# EasyEDA Pro project ProProject_IMUSensorNodes202312.epro, board 6_6_拼板20240123（不带编号） (continued)
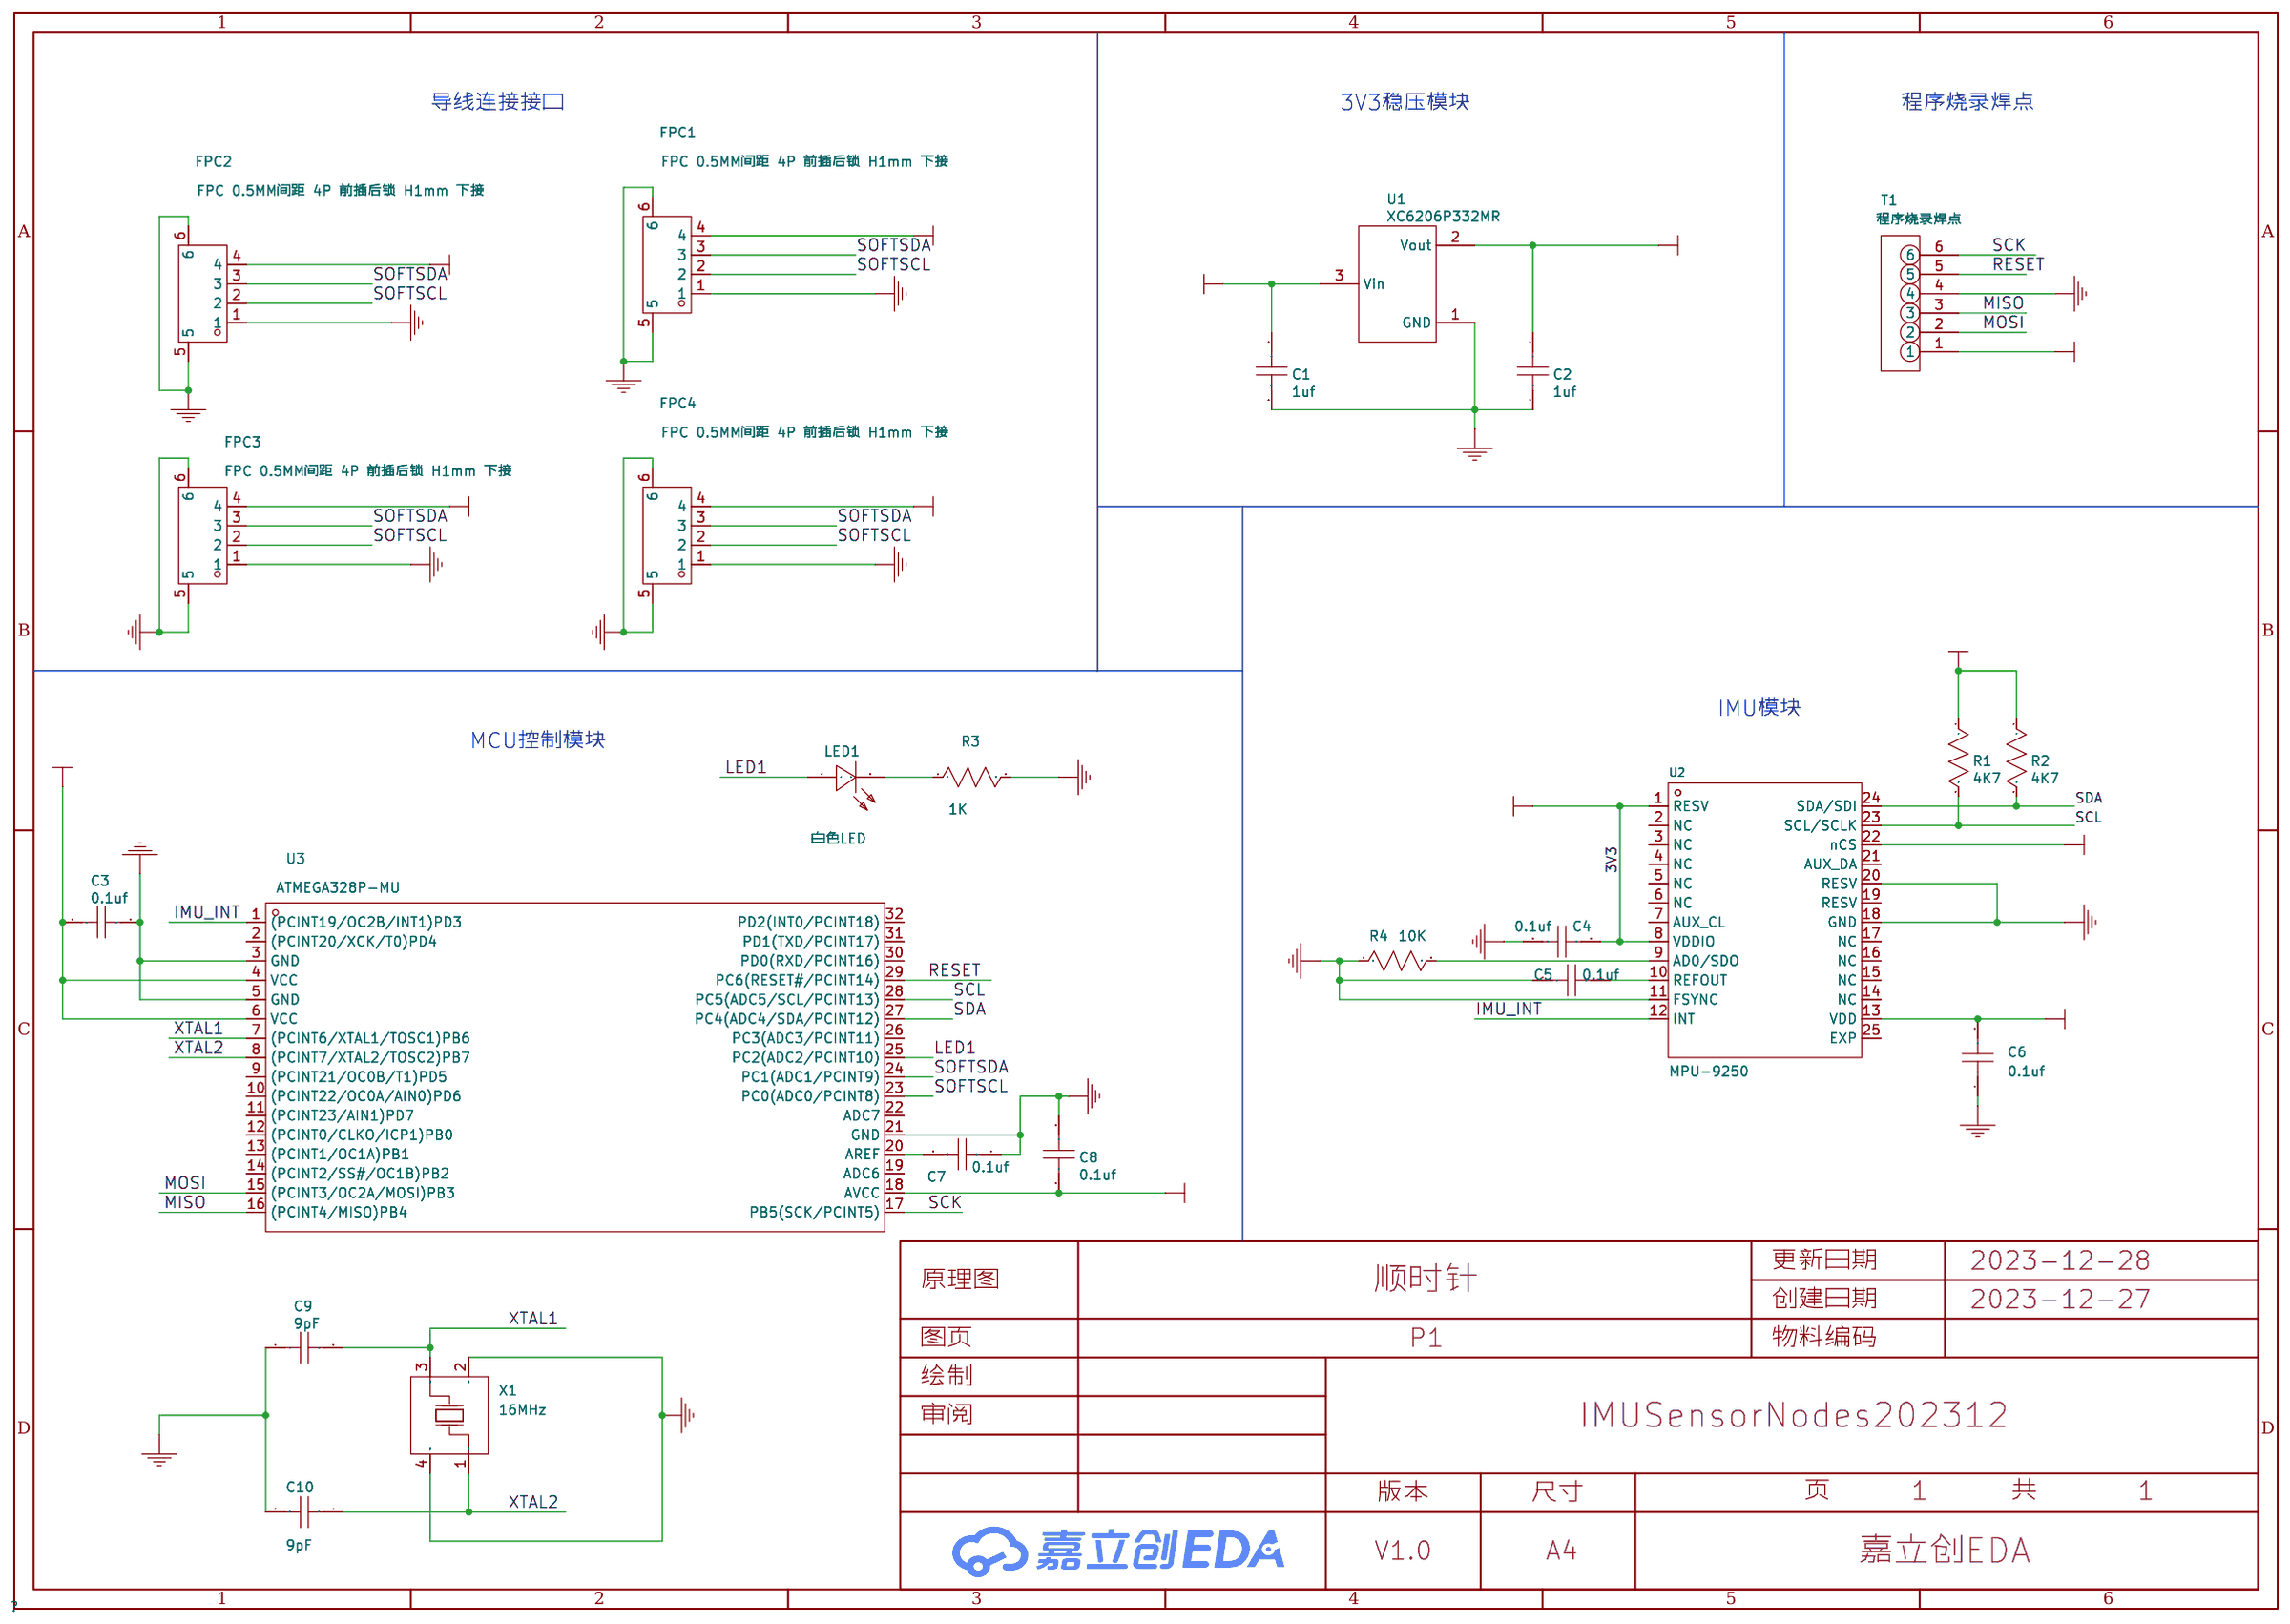
[diagram p0: schematic sheet]
## Nets (continued)
SOFTSCL: FPC1.3 FPC1#2.3 FPC1#3.2 FPC1#4.3 FPC1#5.3 FPC1#6.3 FPC1#7.2 FPC1#8.3 FPC1#9.2 FPC1#10.2 FPC1#11.2 FPC1#12.3 FPC1#13.3 FPC1#14.3 FPC1#15.2 FPC1#16.2 FPC1#17.3 FPC1#18.3 FPC1#19.2 FPC1#20.2 FPC1#21.3 FPC1#22.2 FPC1#23.2 FPC1#24.3 FPC1#25.2 FPC1#26.2 FPC1#27.2 FPC1#28.3 FPC1#29.2 FPC1#30.2 FPC1#31.3 FPC1#32.3 FPC1#33.2 FPC1#34.3 FPC1#35.2 FPC1#36.3 FPC2.2 FPC2#2.2 FPC2#3.2 FPC2#4.3 FPC2#5.2 FPC2#6.3 FPC2#7.3 FPC2#8.3 FPC2#9.3 FPC2#10.3 FPC2#11.3 FPC2#12.3 FPC2#13.3 FPC2#14.2 FPC2#15.2 FPC2#16.2 FPC2#17.2 FPC2#18.2 FPC2#19.3 FPC2#20.2 FPC2#21.3 FPC2#22.2 FPC2#23.3 FPC2#24.2 FPC2#25.3 FPC2#26.2 FPC2#27.2 FPC2#28.2 FPC2#29.2 FPC2#30.2 FPC2#31.2 FPC2#32.3 FPC2#33.3 FPC2#34.3 FPC2#35.3 FPC2#36.3 FPC3.3 FPC3#2.2 FPC3#3.2 FPC3#4.2 FPC3#5.3 FPC3#6.3 FPC3#7.2 FPC3#8.3 FPC3#9.2 FPC3#10.3 FPC3#11.2 FPC3#12.3 FPC3#13.3 FPC3#14.3 FPC3#15.3 FPC3#16.2 FPC3#17.3 FPC3#18.2 FPC3#19.2 FPC3#20.3 FPC3#21.2 FPC3#22.2 FPC3#23.2 FPC3#24.2 FPC3#25.3 FPC3#26.3 FPC3#27.3 FPC3#28.2 FPC3#29.2 FPC3#30.3 FPC3#31.3 FPC3#32.3 FPC3#33.2 FPC3#34.2 FPC3#35.2 FPC3#36.3 FPC4.3 FPC4#2.2 FPC4#3.3 FPC4#4.2 FPC4#5.2 FPC4#6.3 FPC4#7.3 FPC4#8.3 FPC4#9.2 FPC4#10.2 FPC4#11.3 FPC4#12.3 FPC4#13.3 FPC4#14.2 FPC4#15.2 FPC4#16.2 FPC4#17.3 FPC4#18.3 FPC4#19.3 FPC4#20.2 FPC4#21.2 FPC4#22.2 FPC4#23.3 FPC4#24.2 FPC4#25.3 FPC4#26.2 FPC4#27.3 FPC4#28.2 FPC4#29.2 FPC4#30.3 FPC4#31.2 FPC4#32.2 FPC4#33.3 FPC4#34.2 FPC4#35.3 FPC4#36.3 U3#61.23 U3#62.23 U3#63.23 U3#64.23 U3#65.23 U3#66.23 U3#67.23 U3#68.23 U3#69.23 U3#70.23 U3#71.23 U3#72.23 U3#73.23 U3#74.23 U3#75.23 U3#76.23 U3#77.23 U3#78.23 U3#79.23 U3#80.23 U3#81.23 U3#82.23 U3#83.23 U3#84.23 U3#85.23 U3#86.23 U3#87.23 U3#88.23 U3#89.23 U3#90.23 U3#91.23 U3#92.23 U3#93.23 U3#94.23 U3#95.23 U3#96.23
SOFTSDA: FPC1.2 FPC1#2.2 FPC1#3.3 FPC1#4.2 FPC1#5.2 FPC1#6.2 FPC1#7.3 FPC1#8.2 FPC1#9.3 FPC1#10.3 FPC1#11.3 FPC1#12.2 FPC1#13.2 FPC1#14.2 FPC1#15.3 FPC1#16.3 FPC1#17.2 FPC1#18.2 FPC1#19.3 FPC1#20.3 FPC1#21.2 FPC1#22.3 FPC1#23.3 FPC1#24.2 FPC1#25.3 FPC1#26.3 FPC1#27.3 FPC1#28.2 FPC1#29.3 FPC1#30.3 FPC1#31.2 FPC1#32.2 FPC1#33.3 FPC1#34.2 FPC1#35.3 FPC1#36.2 FPC2.3 FPC2#2.3 FPC2#3.3 FPC2#4.2 FPC2#5.3 FPC2#6.2 FPC2#7.2 FPC2#8.2 FPC2#9.2 FPC2#10.2 FPC2#11.2 FPC2#12.2 FPC2#13.2 FPC2#14.3 FPC2#15.3 FPC2#16.3 FPC2#17.3 FPC2#18.3 FPC2#19.2 FPC2#20.3 FPC2#21.2 FPC2#22.3 FPC2#23.2 FPC2#24.3 FPC2#25.2 FPC2#26.3 FPC2#27.3 FPC2#28.3 FPC2#29.3 FPC2#30.3 FPC2#31.3 FPC2#32.2 FPC2#33.2 FPC2#34.2 FPC2#35.2 FPC2#36.2 FPC3.2 FPC3#2.3 FPC3#3.3 FPC3#4.3 FPC3#5.2 FPC3#6.2 FPC3#7.3 FPC3#8.2 FPC3#9.3 FPC3#10.2 FPC3#11.3 FPC3#12.2 FPC3#13.2 FPC3#14.2 FPC3#15.2 FPC3#16.3 FPC3#17.2 FPC3#18.3 FPC3#19.3 FPC3#20.2 FPC3#21.3 FPC3#22.3 FPC3#23.3 FPC3#24.3 FPC3#25.2 FPC3#26.2 FPC3#27.2 FPC3#28.3 FPC3#29.3 FPC3#30.2 FPC3#31.2 FPC3#32.2 FPC3#33.3 FPC3#34.3 FPC3#35.3 FPC3#36.2 FPC4.2 FPC4#2.3 FPC4#3.2 FPC4#4.3 FPC4#5.3 FPC4#6.2 FPC4#7.2 FPC4#8.2 FPC4#9.3 FPC4#10.3 FPC4#11.2 FPC4#12.2 FPC4#13.2 FPC4#14.3 FPC4#15.3 FPC4#16.3 FPC4#17.2 FPC4#18.2 FPC4#19.2 FPC4#20.3 FPC4#21.3 FPC4#22.3 FPC4#23.2 FPC4#24.3 FPC4#25.2 FPC4#26.3 FPC4#27.2 FPC4#28.3 FPC4#29.3 FPC4#30.2 FPC4#31.3 FPC4#32.3 FPC4#33.2 FPC4#34.3 FPC4#35.2 FPC4#36.2 U3#61.24 U3#62.24 U3#63.24 U3#64.24 U3#65.24 U3#66.24 U3#67.24 U3#68.24 U3#69.24 U3#70.24 U3#71.24 U3#72.24 U3#73.24 U3#74.24 U3#75.24 U3#76.24 U3#77.24 U3#78.24 U3#79.24 U3#80.24 U3#81.24 U3#82.24 U3#83.24 U3#84.24 U3#85.24 U3#86.24 U3#87.24 U3#88.24 U3#89.24 U3#90.24 U3#91.24 U3#92.24 U3#93.24 U3#94.24 U3#95.24 U3#96.24
XTAL1: C9.2 C9#2.2 C9#3.2 C9#4.2 C9#5.2 C9#6.2 C9#7.2 C9#8.2 C9#9.2 C9#10.2 C9#11.2 C9#12.2 C9#13.2 C9#14.2 C9#15.2 C9#16.2 C9#17.2 C9#18.2 C9#19.2 C9#20.2 C9#21.2 C9#22.2 C9#23.2 C9#24.2 C9#25.2 C9#26.2 C9#27.2 C9#28.2 C9#29.2 C9#30.2 C9#31.2 C9#32.2 C9#33.2 C9#34.2 C9#35.2 C9#36.2 U3#61.7 U3#62.7 U3#63.7 U3#64.7 U3#65.7 U3#66.7 U3#67.7 U3#68.7 U3#69.7 U3#70.7 U3#71.7 U3#72.7 U3#73.7 U3#74.7 U3#75.7 U3#76.7 U3#77.7 U3#78.7 U3#79.7 U3#80.7 U3#81.7 U3#82.7 U3#83.7 U3#84.7 U3#85.7 U3#86.7 U3#87.7 U3#88.7 U3#89.7 U3#90.7 U3#91.7 U3#92.7 U3#93.7 U3#94.7 U3#95.7 U3#96.7 X1.3 X1#2.3 X1#3.3 X1#4.3 X1#5.3 X1#6.3 X1#7.3 X1#8.3 X1#9.3 X1#10.3 X1#11.3 X1#12.3 X1#13.3 X1#14.3 X1#15.3 X1#16.3 X1#17.3 X1#18.3 X1#19.3 X1#20.3 X1#21.3 X1#22.3 X1#23.3 X1#24.3 X1#25.3 X1#26.3 X1#27.3 X1#28.3 X1#29.3 X1#30.3 X1#31.3 X1#32.3 X1#33.3 X1#34.3 X1#35.3 X1#36.3
XTAL2: C10.1 C10#2.1 C10#3.1 C10#4.1 C10#5.1 C10#6.1 C10#7.1 C10#8.1 C10#9.1 C10#10.1 C10#11.1 C10#12.1 C10#13.1 C10#14.1 C10#15.1 C10#16.1 C10#17.1 C10#18.1 C10#19.1 C10#20.1 C10#21.1 C10#22.1 C10#23.1 C10#24.1 C10#25.1 C10#26.1 C10#27.1 C10#28.1 C10#29.1 C10#30.1 C10#31.1 C10#32.1 C10#33.1 C10#34.1 C10#35.1 C10#36.1 U3#61.8 U3#62.8 U3#63.8 U3#64.8 U3#65.8 U3#66.8 U3#67.8 U3#68.8 U3#69.8 U3#70.8 U3#71.8 U3#72.8 U3#73.8 U3#74.8 U3#75.8 U3#76.8 U3#77.8 U3#78.8 U3#79.8 U3#80.8 U3#81.8 U3#82.8 U3#83.8 U3#84.8 U3#85.8 U3#86.8 U3#87.8 U3#88.8 U3#89.8 U3#90.8 U3#91.8 U3#92.8 U3#93.8 U3#94.8 U3#95.8 U3#96.8 X1.1 X1#2.1 X1#3.1 X1#4.1 X1#5.1 X1#6.1 X1#7.1 X1#8.1 X1#9.1 X1#10.1 X1#11.1 X1#12.1 X1#13.1 X1#14.1 X1#15.1 X1#16.1 X1#17.1 X1#18.1 X1#19.1 X1#20.1 X1#21.1 X1#22.1 X1#23.1 X1#24.1 X1#25.1 X1#26.1 X1#27.1 X1#28.1 X1#29.1 X1#30.1 X1#31.1 X1#32.1 X1#33.1 X1#34.1 X1#35.1 X1#36.1
$1N1083: LED1#2.2 LED1#4.2 LED1#7.2 LED1#9.2 LED1#11.2 LED1#13.2 LED1#15.2 LED1#17.2 LED1#19.2 LED1#20.2 LED1#22.2 LED1#24.2 LED1#26.2 LED1#28.2 LED1#30.2 LED1#32.2 LED1#34.2 LED1#36.2 R3#2.1 R3#4.1 R3#7.1 R3#9.1 R3#11.1 R3#13.1 R3#15.1 R3#17.1 R3#19.1 R3#20.1 R3#22.1 R3#24.1 R3#26.1 R3#28.1 R3#30.1 R3#32.1 R3#34.1 R3#36.1
$1N1108: C7#2.2 C7#4.2 C7#7.2 C7#9.2 C7#11.2 C7#13.2 C7#15.2 C7#17.2 C7#19.2 C7#20.2 C7#22.2 C7#24.2 C7#26.2 C7#28.2 C7#30.2 C7#32.2 C7#34.2 C7#36.2 U3#63.20 U3#65.20 U3#66.20 U3#68.20 U3#70.20 U3#72.20 U3#73.20 U3#74.20 U3#75.20 U3#76.20 U3#77.20 U3#82.20 U3#85.20 U3#89.20 U3#91.20 U3#92.20 U3#93.20 U3#96.20
$1N1134: LED1.2 LED1#3.2 LED1#5.2 LED1#6.2 LED1#8.2 LED1#10.2 LED1#12.2 LED1#14.2 LED1#16.2 LED1#18.2 LED1#21.2 LED1#23.2 LED1#25.2 LED1#27.2 LED1#29.2 LED1#31.2 LED1#33.2 LED1#35.2 R3.1 R3#3.1 R3#5.1 R3#6.1 R3#8.1 R3#10.1 R3#12.1 R3#14.1 R3#16.1 R3#18.1 R3#21.1 R3#23.1 R3#25.1 R3#27.1 R3#29.1 R3#31.1 R3#33.1 R3#35.1
$1N1156: C7.2 C7#3.2 C7#5.2 C7#6.2 C7#8.2 C7#10.2 C7#12.2 C7#14.2 C7#16.2 C7#18.2 C7#21.2 C7#23.2 C7#25.2 C7#27.2 C7#29.2 C7#31.2 C7#33.2 C7#35.2 U3#61.20 U3#62.20 U3#64.20 U3#67.20 U3#69.20 U3#71.20 U3#78.20 U3#79.20 U3#80.20 U3#81.20 U3#83.20 U3#84.20 U3#86.20 U3#87.20 U3#88.20 U3#90.20 U3#94.20 U3#95.20
$1N1216: R4.2 R4#2.2 R4#4.2 R4#6.2 R4#7.2 R4#9.2 R4#11.2 R4#14.2 R4#16.2 R4#18.2 R4#21.2 R4#23.2 R4#25.2 R4#27.2 R4#29.2 R4#31.2 R4#33.2 R4#35.2 U2#2.9 U2#3.9 U2#5.9 U2#6.9 U2#7.9 U2#12.9 U2#14.9 U2#16.9 U2#18.9 U2#19.9 U2#20.9 U2#22.9 U2#24.9 U2#28.9 U2#32.9 U2#34.9 U2#35.9 U2#36.9
$1N1217: C5.2 C5#3.2 C5#5.2 C5#7.2 C5#8.2 C5#10.2 C5#12.2 C5#15.2 C5#17.2 C5#19.2 C5#21.2 C5#24.2 C5#26.2 C5#28.2 C5#30.2 C5#32.2 C5#34.2 C5#36.2 U2#2.10 U2#3.10 U2#5.10 U2#6.10 U2#7.10 U2#12.10 U2#14.10 U2#16.10 U2#18.10 U2#19.10 U2#20.10 U2#22.10 U2#24.10 U2#28.10 U2#32.10 U2#34.10 U2#35.10 U2#36.10
$1N1698: R4#3.2 R4#5.2 R4#8.2 R4#10.2 R4#12.2 R4#13.2 R4#15.2 R4#17.2 R4#19.2 R4#20.2 R4#22.2 R4#24.2 R4#26.2 R4#28.2 R4#30.2 R4#32.2 R4#34.2 R4#36.2 U2.9 U2#4.9 U2#8.9 U2#9.9 U2#10.9 U2#11.9 U2#13.9 U2#15.9 U2#17.9 U2#21.9 U2#23.9 U2#25.9 U2#26.9 U2#27.9 U2#29.9 U2#30.9 U2#31.9 U2#33.9
$1N1725: C5#2.2 C5#4.2 C5#6.2 C5#9.2 C5#11.2 C5#13.2 C5#14.2 C5#16.2 C5#18.2 C5#20.2 C5#22.2 C5#23.2 C5#25.2 C5#27.2 C5#29.2 C5#31.2 C5#33.2 C5#35.2 U2.10 U2#4.10 U2#8.10 U2#9.10 U2#10.10 U2#11.10 U2#13.10 U2#15.10 U2#17.10 U2#21.10 U2#23.10 U2#25.10 U2#26.10 U2#27.10 U2#29.10 U2#30.10 U2#31.10 U2#33.10

Pads without a net: U2 2 3 4 5 6 14 15 16 17 19 21; U2#2 2 3 4 5 6 7 14 15 16 17 19 21; U2#3 2 3 4 5 6 7 14 15 16 17 19 21; U2#4 2 3 4 5 6 14 15 16 17 19 21; U2#5 2 3 4 5 6 7 14 15 16 17 19 21; U2#6 2 3 4 5 6 7 14 15 16 17 19 21; U2#7 2 3 4 5 6 7 14 15 16 17 19 21; U2#8 2 3 4 5 6 14 15 16 17 19 21; U2#9 2 3 4 5 6 14 15 16 17 19 21; U2#10 2 3 4 5 6 14 15 16 17 19 21; U2#11 2 3 4 5 6 14 15 16 17 19 21; U2#12 2 3 4 5 6 7 14 15 16 17 19 21; U2#13 2 3 4 5 6 14 15 16 17 19 21; U2#14 2 3 4 5 6 7 14 15 16 17 19 21; U2#15 2 3 4 5 6 14 15 16 17 19 21; U2#16 2 3 4 5 6 7 14 15 16 17 19 21; U2#17 2 3 4 5 6 14 15 16 17 19 21; U2#18 2 3 4 5 6 7 14 15 16 17 19 21; U2#19 2 3 4 5 6 7 14 15 16 17 19 21; U2#20 2 3 4 5 6 7 14 15 16 17 19 21; U2#21 2 3 4 5 6 14 15 16 17 19 21; U2#22 2 3 4 5 6 7 14 15 16 17 19 21; U2#23 2 3 4 5 6 14 15 16 17 19 21; U2#24 2 3 4 5 6 7 14 15 16 17 19 21; U2#25 2 3 4 5 6 14 15 16 17 19 21; U2#26 2 3 4 5 6 14 15 16 17 19 21; U2#27 2 3 4 5 6 14 15 16 17 19 21; U2#28 2 3 4 5 6 7 14 15 16 17 19 21; U2#29 2 3 4 5 6 14 15 16 17 19 21; U2#30 2 3 4 5 6 14 15 16 17 19 21; U2#31 2 3 4 5 6 14 15 16 17 19 21; U2#32 2 3 4 5 6 7 14 15 16 17 19 21; U2#33 2 3 4 5 6 14 15 16 17 19 21; U2#34 2 3 4 5 6 7 14 15 16 17 19 21; U2#35 2 3 4 5 6 7 14 15 16 17 19 21; U2#36 2 3 4 5 6 7 14 15 16 17 19 21; U3 1 2 3 4 5 6 7 8 9 10 11 12 13 14 15 16; U3#2 1 2 3 4 5 6 7 8 9 10 11 12 13 14 15 16; U3#3 1 2 3 4 5 6 7 8 9 10 11 12 13 14 15 16; U3#4 1 2 3 4 5 6 7 8 9 10 11 12 13 14 15 16; U3#5 1 2 3 4 5 6 7 8 9 10 11 12 13 14 15 16; U3#6 1 2 3 4 5 6 7 8 9 10 11 12 13 14 15 16; U3#7 1 2 3 4 5 6 7 8 9 10 11 12 13 14 15 16; U3#8 1 2 3 4 5 6 7 8 9 10 11 12 13 14 15 16; U3#9 1 2 3 4 5 6 7 8 9 10 11 12 13 14 15 16; U3#10 1 2 3 4 5 6 7 8 9 10 11 12 13 14 15 16; U3#11 1 2 3 4 5 6 7 8 9 10 11 12 13 14 15 16; U3#12 1 2 3 4 5 6 7 8 9 10 11 12 13 14 15 16; U3#13 1 2 3 4 5 6 7 8 9 10 11 12 13 14 15 16; U3#14 1 2 3 4 5 6 7 8 9 10 11 12 13 14 15 16; U3#15 1 2 3 4 5 6 7 8 9 10 11 12 13 14 15 16; U3#16 1 2 3 4 5 6 7 8 9 10 11 12 13 14 15 16; U3#17 1 2 3 4 5 6 7 8 9 10 11 12 13 14 15 16; U3#18 1 2 3 4 5 6 7 8 9 10 11 12 13 14 15 16; U3#19 1 2 3 4 5 6 7 8 9 10 11 12 13 14 15 16; U3#20 1 2 3 4 5 6 7 8 9 10 11 12 13 14 15 16; U3#21 1 2 3 4 5 6 7 8 9 10 11 12 13 14 15 16; U3#22 1 2 3 4 5 6 7 8 9 10 11 12 13 14 15 16; U3#23 1 2 3 4 5 6 7 8 9 10 11 12 13 14 15 16; U3#24 1 2 3 4 5 6 7 8 9 10 11 12 13 14 15 16; U3#25 1 2 3 4 5 6 7 8 9 10 11 12 13 14 15 16; U3#26 1 2 3 4 5 6 7 8 9 10 11 12 13 14 15 16; U3#27 1 2 3 4 5 6 7 8 9 10 11 12 13 14 15 16; U3#28 1 2 3 4 5 6 7 8 9 10 11 12 13 14 15 16; U3#29 1 2 3 4 5 6 7 8 9 10 11 12 13 14 15 16; U3#30 1 2 3 4 5 6 7 8 9 10 11 12 13 14 15 16; U3#31 1 2 3 4 5 6 7 8 9 10 11 12 13 14 15 16; U3#32 1 2 3 4 5 6 7 8 9 10 11 12 13 14 15 16; U3#33 1 2 3 4 5 6 7 8 9 10 11 12 13 14 15 16; U3#34 1 2 3 4 5 6 7 8 9 10 11 12 13 14 15 16; U3#35 1 2 3 4 5 6 7 8 9 10 11 12 13 14 15 16; U3#36 1 2 3 4 5 6 7 8 9 10 11 12 13 14 15 16; U3#37 1 2 3 4 5 6 7 8 9 10 11 12 13 14 15 16; U3#38 1 2 3 4 5 6 7 8 9 10 11 12 13 14 15 16; U3#39 1 2 3 4 5 6 7 8 9 10 11 12 13 14 15 16; U3#40 1 2 3 4 5 6 7 8 9 10 11 12 13 14 15 16; U3#41 1 2 3 4 5 6 7 8 9 10 11 12 13 14 15 16; U3#42 1 2 3 4 5 6 7 8 9 10 11 12 13 14 15 16; U3#43 1 2 3 4 5 6 7 8 9 10 11 12 13 14 15 16; U3#44 1 2 3 4 5 6 7 8 9 10 11 12 13 14 15 16; U3#45 1 2 3 4 5 6 7 8 9 10 11 12 13 14 15 16; U3#46 1 2 3 4 5 6 7 8 9 10 11 12 13 14 15 16; U3#47 1 2 3 4 5 6 7 8 9 10 11 12 13 14 15 16; U3#48 1 2 3 4 5 6 7 8 9 10 11 12 13 14 15 16; U3#49 1 2 3 4 5 6 7 8 9 10 11 12 13 14 15 16; U3#50 1 2 3 4 5 6 7 8 9 10 11 12 13 14 15 16; U3#51 1 2 3 4 5 6 7 8 9 10 11 12 13 14 15 16; U3#52 1 2 3 4 5 6 7 8 9 10 11 12 13 14 15 16; U3#53 1 2 3 4 5 6 7 8 9 10 11 12 13 14 15 16; U3#54 1 2 3 4 5 6 7 8 9 10 11 12 13 14 15 16; U3#55 1 2 3 4 5 6 7 8 9 10 11 12 13 14 15 16; U3#56 1 2 3 4 5 6 7 8 9 10 11 12 13 14 15 16; U3#57 1 2 3 4 5 6 7 8 9 10 11 12 13 14 15 16; U3#58 1 2 3 4 5 6 7 8 9 10 11 12 13 14 15 16; U3#59 1 2 3 4 5 6 7 8 9 10 11 12 13 14 15 16; U3#60 1 2 3 4 5 6 7 8 9 10 11 12 13 14 15 16; U3#61 2 9 10 11 12 14 19 31 32; U3#62 2 9 10 11 12 14 19 31 32; U3#63 2 10 11 12 13 19 32; U3#64 2 9 10 11 12 14 19 31 32; U3#65 2 10 11 12 13 19 32; U3#66 2 10 11 12 13 19 32; U3#67 2 9 10 11 12 14 19 31 32; U3#68 2 10 11 12 13 19 32; U3#69 2 9 10 11 12 14 19 31 32; U3#70 2 10 11 12 13 19 32; U3#71 2 9 10 11 12 14 19 31 32; U3#72 2 10 11 12 13 19 32; U3#73 2 10 11 12 13 19 32; U3#74 2 10 11 12 13 19 32; U3#75 2 10 11 12 13 19 32; U3#76 2 10 11 12 13 19 32; U3#77 2 10 11 12 13 19 32; U3#78 2 9 10 11 12 14 19 31 32; U3#79 2 9 10 11 12 14 19 31 32; U3#80 2 9 10 11 12 14 19 31 32; U3#81 2 9 10 11 12 14 19 31 32; U3#82 2 10 11 12 13 19 32; U3#83 2 9 10 11 12 14 19 31 32; U3#84 2 9 10 11 12 14 19 31 32; U3#85 2 10 11 12 13 19 32; U3#86 2 9 10 11 12 14 19 31 32; U3#87 2 9 10 11 12 14 19 31 32; U3#88 2 9 10 11 12 14 19 31 32; U3#89 2 10 11 12 13 19 32; U3#90 2 9 10 11 12 14 19 31 32; U3#91 2 10 11 12 13 19 32; U3#92 2 10 11 12 13 19 32; U3#93 2 10 11 12 13 19 32; U3#94 2 9 10 11 12 14 19 31 32; U3#95 2 9 10 11 12 14 19 31 32; U3#96 2 10 11 12 13 19 32

## Via types
v1: diameter 0.5, hole 0.3, Top Layer to Bottom Layer, 1188 vias
v2: diameter 0.5, hole 0.299, Top Layer to Bottom Layer, 108 vias

## Routing (per net, layer and track width the routed paths; a pad name or vN(x,y) marks a point on that pad's centre or on a via; arc(x,y) is an arc through that point)
3V3: length 1145
  Top Layer w0.254: v1(75.22,14.89) 76.99,16.67 v1(76.99,17.56) ; v1(28.22,51.84) 28.22,50.7 v1(28.35,50.58) 28.48,50.45 29.68,50.45 v1(29.77,50.36) ; v1(2.46,9.21) 2.37,9.3 1.17,9.3 v1(1.05,9.43) 0.92,9.55 v1(0.92,10.7) ; v1(16.16,8.92) 15.45,8.92 v1(14.94,9.43) ; v1(55.53,24.41) 55.53,23.27 v1(55.66,23.14) 55.78,23.02 56.98,23.02 v1(57.07,22.92) ; v1(43.47,22.64) 42.75,22.64 v1(42.25,23.14) ; v1(2.46,36.64) 2.37,36.73 1.17,36.73 v1(1.05,36.86) 0.92,36.99 v1(0.92,38.13) ; v1(47.91,28.6) 49.69,30.38 v1(49.69,31.27) ; v1(20.6,56.04) 22.38,57.81 v1(22.38,58.7) ; v1(75.22,1.17) 76.99,2.95 v1(76.99,3.84) ; v1(42.25,78.01) 42.75,77.5 v1(43.47,77.5) ; v1(75.22,56.04) 76.99,57.81 v1(76.99,58.7) ; v1(47.91,14.89) 49.69,16.67 v1(49.69,17.56) ; v1(69.55,64.29) 70.06,63.78 v1(70.77,63.78) ; v1(43.47,36.35) 42.75,36.35 v1(42.25,36.86) ; v1(69.55,36.86) 70.06,36.35 v1(70.77,36.35) ; v1(49.69,72.42) 49.69,71.53 v1(47.91,69.75) ; v1(69.55,50.58) 70.06,50.07 v1(70.77,50.07) ; v1(75.22,42.32) 76.99,44.1 v1(76.99,44.99) ; v1(70.77,8.92) 70.06,8.92 v1(69.55,9.43) ; v1(55.53,10.7) 55.53,9.55 v1(55.66,9.43) 55.78,9.3 56.98,9.3 v1(57.07,9.21) ; v1(47.91,42.32) 49.69,44.1 v1(49.69,44.99) ; v1(22.38,72.42) 22.38,71.53 v1(20.6,69.75) ; v1(14.94,78.01) 15.45,77.5 v1(16.16,77.5) ; v1(57.07,64.07) 56.98,64.16 55.78,64.16 v1(55.66,64.29) 55.53,64.42 v1(55.53,65.56) ; v1(29.77,77.79) 29.68,77.88 28.48,77.88 v1(28.35,78.01) 28.22,78.13 v1(28.22,79.28) ; v1(22.38,17.56) 22.38,16.67 v1(20.6,14.89) ; v1(70.77,77.5) 70.06,77.5 v1(69.55,78.01) ; v1(29.77,36.64) 29.68,36.73 28.48,36.73 v1(28.35,36.86) 28.22,36.99 v1(28.22,38.13) ; v1(28.22,24.41) 28.22,23.27 v1(28.35,23.14) 28.48,23.02 29.68,23.02 v1(29.77,22.92) ; v1(14.94,23.14) 15.45,22.64 v1(16.16,22.64) ; v1(49.69,58.7) 49.69,57.81 v1(47.91,56.04) ; v1(42.25,50.58) 42.75,50.07 v1(43.47,50.07) ; v1(57.07,36.64) 56.98,36.73 55.78,36.73 v1(55.66,36.86) 55.53,36.99 v1(55.53,38.13) ; v1(49.69,3.84) 49.69,2.95 v1(47.91,1.17) ; v1(14.94,50.58) 15.45,50.07 v1(16.16,50.07) ; v1(22.38,31.27) 22.38,30.38 v1(20.6,28.6) ; v1(28.22,10.7) 28.22,9.55 v1(28.35,9.43) 28.48,9.3 29.68,9.3 v1(29.77,9.21) ; v1(57.07,50.36) 56.98,50.45 55.78,50.45 v1(55.66,50.58) 55.53,50.7 v1(55.53,51.84) ; v1(16.16,36.35) 15.45,36.35 v1(14.94,36.86) ; v1(75.22,28.6) 76.99,30.38 v1(76.99,31.27) ; v1(57.07,77.79) 56.98,77.88 55.78,77.88 v1(55.66,78.01) 55.53,78.13 v1(55.53,79.28) ; v1(0.92,65.56) 0.92,64.42 v1(1.05,64.29) 1.17,64.16 2.37,64.16 v1(2.46,64.07) ; v1(76.99,72.42) 76.99,71.53 v1(75.22,69.75) ; v1(42.25,9.43) 42.75,8.92 v1(43.47,8.92) ; v1(22.38,44.99) 22.38,44.1 v1(20.6,42.32) ; v1(2.46,77.79) 2.37,77.88 1.17,77.88 v1(1.05,78.01) 0.92,78.13 v1(0.92,79.28) ; v1(69.55,23.14) 70.06,22.64 v1(70.77,22.64) ; v1(43.47,63.78) 42.75,63.78 v1(42.25,64.29) ; v1(29.77,64.07) 29.68,64.16 28.48,64.16 v1(28.35,64.29) 28.22,64.42 v1(28.22,65.56) ; v1(0.92,24.41) 0.92,23.27 v1(1.05,23.14) 1.17,23.02 2.37,23.02 v1(2.46,22.92) ; v1(16.16,63.78) 15.45,63.78 v1(14.94,64.29) ; v1(20.6,1.17) 22.38,2.95 v1(22.38,3.84) ; v1(2.46,50.36) 2.37,50.45 1.17,50.45 v1(1.05,50.58) 0.92,50.7 v1(0.92,51.84)
  Bottom Layer w0.2: 1.81,11.46 3.59,11.46 3.6,11.44 U2#11.1 ; U2#23.1 58.21,11.44 58.2,11.46 56.42,11.46 ; 1.81,52.61 3.59,52.61 3.6,52.59 U2#30.1 ; 1.81,80.04 3.59,80.04 3.6,80.02 U2.1 ; U2#33.1 3.6,25.16 3.59,25.17 1.81,25.17 ; 56.42,38.89 58.2,38.89 58.21,38.87 U2#10.1 ; U2#26.1 58.21,52.59 58.2,52.61 56.42,52.61 ; U2#17.1 58.21,25.16 58.2,25.17 56.42,25.17 ; U2#4.1 3.6,38.87 3.59,38.89 1.81,38.89 ; U2#31.1 30.91,66.31 30.89,66.32 29.11,66.32 ; U2#8.1 30.91,38.87 30.89,38.89 29.11,38.89 ; 29.11,80.04 30.89,80.04 30.91,80.02 U2#27.1 ; U2#21.1 30.91,52.59 30.89,52.61 29.11,52.61 ; U2#29.1 3.6,66.31 3.59,66.32 1.81,66.32 ; U2#9.1 30.91,25.16 30.89,25.17 29.11,25.17 ; U2#15.1 58.21,80.02 58.2,80.04 56.42,80.04 ; U2#25.1 30.91,11.44 30.89,11.46 29.11,11.46 ; 56.42,66.32 58.2,66.32 58.21,66.31 U2#13.1